# EasyEDA Pro project ProPrj_Starcat_FOC双路矢量控制器_2024-11-11.epro, schematic FOC_cdh_2 (continued)
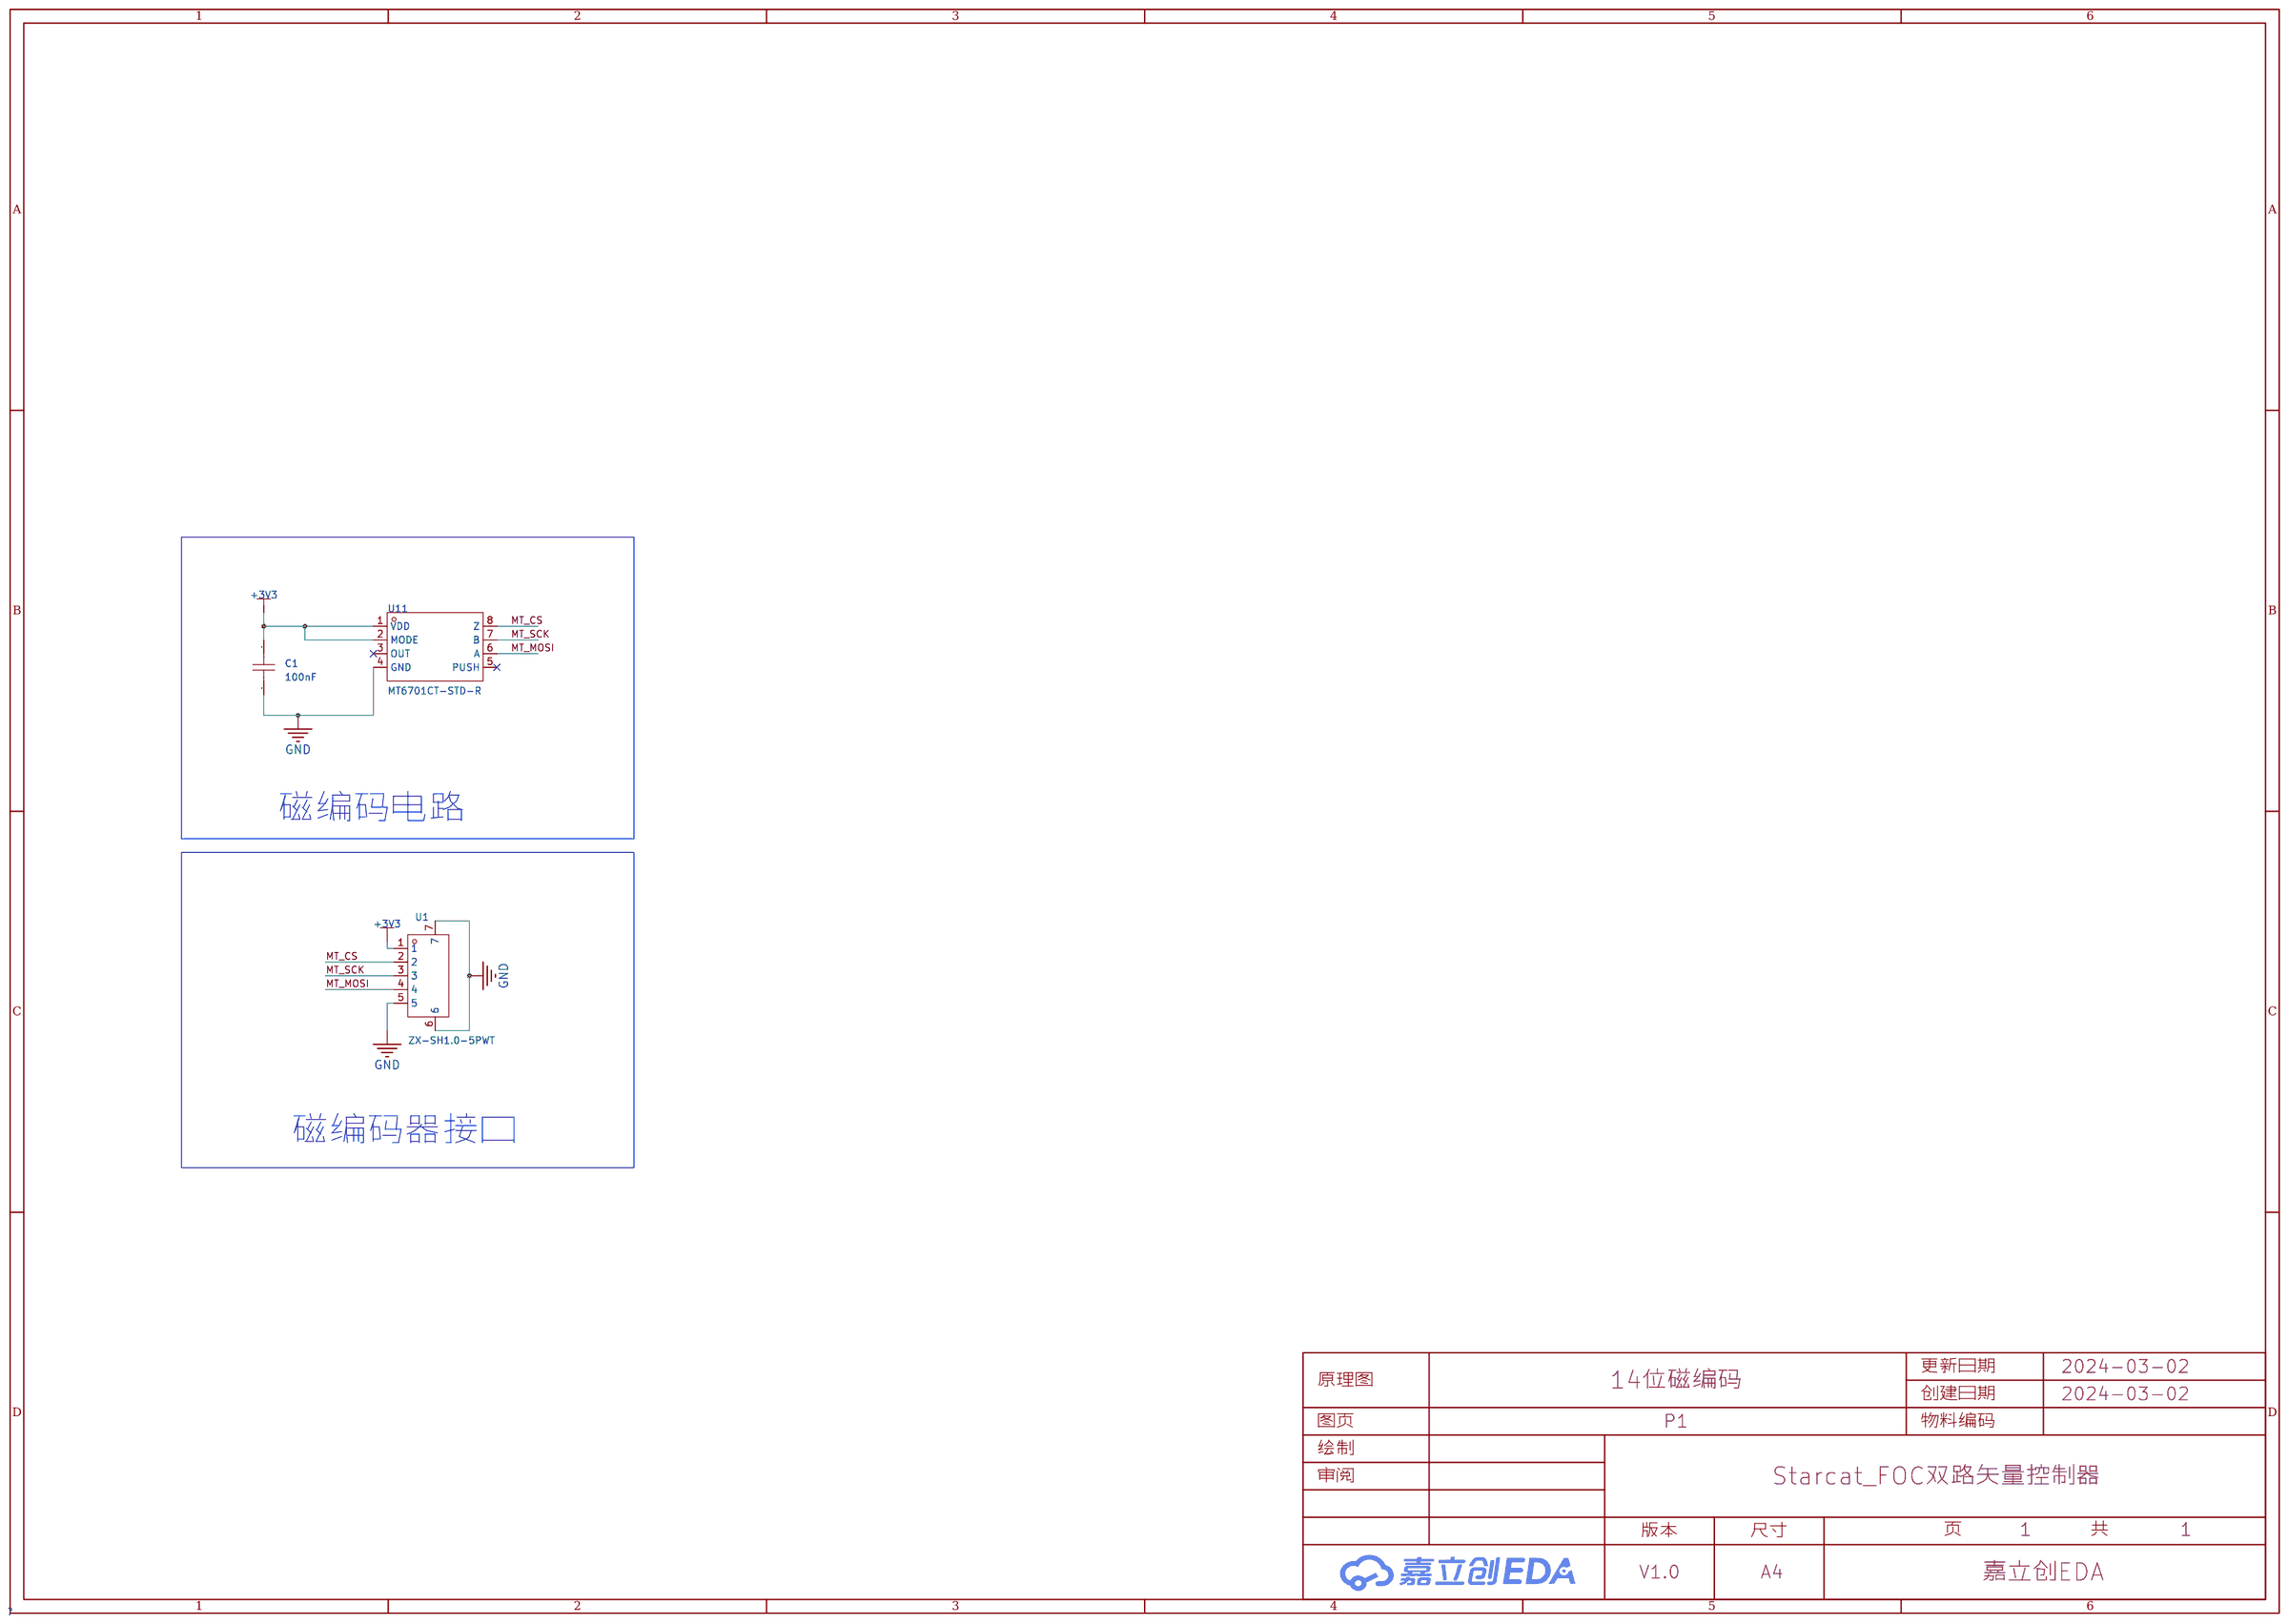
[diagram p0: schematic sheet]
## Library data of the parts (continued)
R18 = 0603WAF5603T5E: 电阻类型:厚膜电阻;阻值:560kΩ;精度:±1%;功率:100mW;最大工作电压:75V;温度系数:±100ppm/℃;; LCSC Part Name: 560kΩ ±1% 100mW 厚膜电阻; Supplier Part: C23203; Manufacturer: UNI-ROYAL(厚声); Supplier Footprint: 0603; JLCPCB Part Class: 扩展库; Datasheet: https://atta.szlcsc.com/upload/public/pdf/source/20200306/C422600_1E6D84923E4A46A82E41ADD87F860B5C.pdf; Supplier: LCSC; Type: 厚膜电阻; Tolerance: ±1%; Power(Watts): 100mW; Overload Voltage (Max): 75V; Temperature Coefficient: ±100ppm/℃; Operating Temperature Range: -55℃~+155℃
R33 R35 R37 R39 R59 R60 = 0603WAF220JT5E: 电阻类型:厚膜电阻;阻值:22Ω;精度:±1%;功率:100mW;最大工作电压:75V;温度系数:±100ppm/℃;; LCSC Part Name: 22Ω ±1% 100mW 厚膜电阻; Supplier Part: C23345; Manufacturer: UNI-ROYAL(厚声); Supplier Footprint: 0603; JLCPCB Part Class: 基础库; Datasheet: https://atta.szlcsc.com/upload/public/pdf/source/20200306/C422600_1E6D84923E4A46A82E41ADD87F860B5C.pdf; Supplier: LCSC; Type: 厚膜电阻; Tolerance: ±1%; Power(Watts): 100mW; Overload Voltage (Max): 75V; Temperature Coefficient: ±100ppm/℃; Operating Temperature Range: -55℃~+155℃
SW1-SW3 = TS24CA 250gf 013: 电路结构:单刀单掷;按钮形状:矩形按钮;作用力:250gf;安装方式:卧贴;开关长度:4.55mm;开关宽度:1.8mm;开关高度:3.5mm;带支架:不带;触点电流:50mA;额定电压(AC):-;额定电压(DC):12V;额定功率:0.6W;绝缘电阻:100MΩ;带灯:无;机械寿命:3万次;; LCSC Part Name: 2*4*3.5mm半包小贝贝TS-018小侧按键m165蓝牙耳机开关 250gf; Supplier Part: C5373430; Manufacturer: SHOU HAN(首韩); Supplier Footprint: SMD; JLCPCB Part Class: 扩展库; Datasheet: https://atta.szlcsc.com/upload/public/pdf/source/20230321/913029B0FB0CD391AF5EFD51697D8EC4.pdf; Supplier: LCSC; Circuit: 单刀单掷; Actuator Style: 矩形按钮; Operating Force: 250gf; Mounting Style: 卧贴; Switch Length: 4.55mm; Switch Width: 1.8mm; Switch Height: 3.5mm; Strike Gundam: 不带; Contact Current: 50mA; Voltage Rating (DC): 12V; Power Rating: 0.6W; Insulation Resistance: 100MΩ; Actuator/Cap Color: 黑色; With Lamp: 无; Mechanical Life: 3万次; Operating Temperature: -40℃~+85℃
TP1-TP4 = Test-Point: Test Point 测试点
U1 = SPX3819M5-L-3-3/TR: 输出类型:固定;最大输入电压:16V;输出电压:3.3V;最大输出电流:500mA;电源纹波抑制比(PSRR):70dB;输出极性:正极;; LCSC Part Name: 输入16V 输出3.3V 500mA; Supplier Part: C9055; Manufacturer: MaxLinear(迈凌); Supplier Footprint: SOT-23-5; JLCPCB Part Class: 扩展库; Datasheet: https://atta.szlcsc.com/upload/public/pdf/source/20150720/1457707331934.pdf; Supplier: LCSC; Output Type: 固定; Maximum Input Voltage: 16V; Output Voltage: 3.3V; MAX Output Current: 500mA; Power Supply Rejection Ratio (PSRR): 70dB; Dropout Voltage: 700mV@(500mA); standby current: 8uA; Operating Temperature: -40℃~+125℃; Output Polarity: 正极; Number of Outputs: 1
U2 = LP5907MFX-3.3/NOPB: 输出类型:固定;最大输入电压:5.5V;输出电压:3.3V;最大输出电流:250mA;电源纹波抑制比(PSRR):90dB;输出极性:正极;; LCSC Part Name: 输入5.5V 输出3.3V 250mA; Supplier Part: C80670; Manufacturer: TI(德州仪器); Supplier Footprint: SOT-23-5; JLCPCB Part Class: 扩展库; Datasheet: https://www.ti.com/cn/lit/gpn/lp5907; Supplier: LCSC; Output Type: 固定; Maximum Input Voltage: 5.5V; Output Voltage: 3.3V; MAX Output Current: 250mA; Power Supply Rejection Ratio (PSRR): 90dB; Dropout Voltage: 250mV@(250mA); standby current: 25uA; Operating Temperature: -40℃~+125℃; Output Polarity: 正极; Number of Outputs: 1
U3 U4 = 舵机驱动
U5 = CH340N: Supplier Part: C2977777; Manufacturer: WCH(南京沁恒); Supplier Footprint: SOP-8; JLCPCB Part Class: Extended Part; Datasheet: https://atta.szlcsc.com/upload/public/pdf/source/20220223/82A45E4FF89B3EDCAD50B354450A7EF4.pdf; Supplier: LCSC
U7 = TLV61046ADBVR: 功能类型:升压型;输出类型:可调;输入电压:1.8V~5.5V;输出电压:3.3V~28V;输出电流(最大值):-;; Supplier Part: C464815; Manufacturer: TI(德州仪器); Supplier Footprint: SOT-23-6; JLCPCB Part Class: 扩展库; Datasheet: https://www.ti.com/cn/lit/gpn/tlv61046a; Supplier: LCSC; Function: 升压型; Output Type: 可调; Input Voltage: 1.8V~5.5V; Output Voltage: 3.3V~28V; Switching Frequency: 1.05MHz; Operating Temperature: -40℃~+125℃@(TJ); Number of Outputs: 1; Topology: 升压式; Switch tube (built-in/external): 内置
U8 U9 = WAFER-SH1.0-2PWB: 插针结构:1x2P;间距:1mm;安装方式:卧贴;总PIN数:2P;排数:1;每排PIN数:2;额定电流:1A;工作温度范围:-25℃~+85℃;; LCSC Part Name: 1x2P 间距:1mm 卧贴; Supplier Part: C3029341; Manufacturer: XUNPU(讯普); Supplier Footprint: SMD,P=1mm,卧贴; JLCPCB Part Class: 扩展库; Datasheet: https://atta.szlcsc.com/upload/public/pdf/source/20220527/1879B8210BD3B2006BCEAC1A40D397B6.pdf; Supplier: LCSC; Pins Structure: 1x2P; Pitch: 1mm; Mounting Style: 卧贴; Number of Pins: 2P; Number of Rows: 1; Number of PINs Per Row: 2; Current Rating (Max): 1A; Operating Temperature Range: -25℃~+85℃
U10 U13 = ZX-SH1.0-5PWT: 插针结构:1x5P;间距:1mm;安装方式:卧贴;参考系列:SH;总PIN数:5P;排数:1;每排PIN数:5;行距:-;额定电流:1A;触头材质:黄铜;触头镀层:锡;工作温度范围:-25℃~+85℃;; Supplier Part: C7430447; Manufacturer: Megastar(兆星); Supplier Footprint: SMD,P=1mm,卧贴; JLCPCB Part Class: 扩展库; Datasheet: https://atta.szlcsc.com/upload/public/pdf/source/20230619/A00B60466F49A3581AA01BB47452619D.pdf; Supplier: LCSC; Pins Structure: 1x5P; Pitch: 1mm; Mounting Style: 卧贴; Reference Series: SH; Number of Pins: 5P; Number of Rows: 1; Number of PINs Per Row: 5; Current Rating (Max): 1A; Contact Material: 黄铜; Contact Plating: 锡; Operating Temperature Range: -25℃~+85℃
U12 = oled-128x80
U16 = STM32F405RGT6: CPU内核:CM4;程序存储容量:1MB;RAM总容量:192KB;GPIO端口数量:51;工作电压范围:1.8V~3.6V;CPU最大主频:168MHz;程序存储器类型:FLASH;; Supplier Part: C15742; Manufacturer: ST(意法半导体); Supplier Footprint: LQFP-64(10x10); JLCPCB Part Class: 扩展库; Datasheet: https://atta.szlcsc.com/upload/public/pdf/source/20140801/1457707197138.pdf; Supplier: LCSC; CPU Core: CM4; Program Storage Size: 1MB; RAM Size: 192KB; GPIO Ports Number: 51; Operating Voltage Range: 1.8V~3.6V; CPU Maximum Speed: 168MHz; Program Memory Type: FLASH; Operating Temperature Range: -40℃~+85℃; ADC (Bit): 12bit; DAC (Bit): 12bit; Universal Serial Bus: 有; Peripheral/Function: DMA；LCD/LED驱动；PWM; Watchdog: 有; Infrared Data Association: 有; Low-Voltage Detect: 有; LCD Module: 有; Direct Memory Access: 有; Internal Oscillator: 有
U19 = SN65HVD232DR: 类型:收发器;数据速率:1Mbps;; LCSC Part Name: 1Mbps 3V~3.6V; Supplier Part: C30530; Manufacturer: TI(德州仪器); Supplier Footprint: SOIC-8; JLCPCB Part Class: 扩展库; Datasheet: https://www.ti.com/cn/lit/gpn/sn65hvd230; Supplier: LCSC; Type: 收发器; Data Rate: 1Mbps; Supply Voltage: 3V~3.6V; Operating Temperature: -40℃~+85℃
USB1 = KH-TYPE-C-16P: 连接器类型:Type-C;标准:-;公母:母座;触点数量:16;端口数量:1;安装方式:卧贴;额定电流 - 电源:3A;工作温度范围:-40℃~+85℃;; LCSC Part Name: Type-C 母座 卧贴; Supplier Part: C709357; Manufacturer: kinghelm(金航标); Supplier Footprint: SMD; JLCPCB Part Class: Extended Part; Datasheet: https://atta.szlcsc.com/upload/public/pdf/source/20200911/C709357_AA8DCEB38BB20E3035A7ED7AE7667837.pdf; Supplier: LCSC; Connector Type: Type-C; Gender: 母座; Number of Contacts: 16; Number of Ports: 1; Mounting Style: 卧贴; Current Rating - Power (Max): 3A; Operating Temperature Range: -40℃~+85℃
X1 = X50328MSB2GI: 晶振类型:贴片无源晶振;频率:8MHz;频率公差:±10ppm;频率稳定度:±50ppm;负载电容:20pF;工作温度:-40℃~+85℃;; LCSC Part Name: YSX530GA 8MHz ±10ppm 20pF; Supplier Part: C115962; Manufacturer: YXC(扬兴晶振); Supplier Footprint: SMD5032-2P; JLCPCB Part Class: 基础库; Datasheet: https://atta.szlcsc.com/upload/public/pdf/source/20210329/C112559_847D3CACBA33ACCEB57DEA3AEBB187A1.pdf; Supplier: LCSC; Crystal Type: 贴片无源晶振; Frequency Tolerance: ±10ppm; Frequency Stability: ±50ppm; Load Capacitance: 20pF; Operating Temperature: -40℃~+85℃
C34-C39 C50-C55 C94 C95 C97 = GRM32ER60J107ME20L: 容值:100uF;精度:±20%;额定电压:6.3V;材质(温度系数):X5R;; LCSC Part Name: 100uF ±20% 6.3V; Supplier Part: C88154; Manufacturer: muRata(村田); Supplier Footprint: 1210; JLCPCB Part Class: 扩展库; Datasheet: https://atta.szlcsc.com/upload/public/pdf/source/20170116/1484561244372.pdf; Supplier: LCSC; Tolerance: ±20%; Voltage Rated: 6.3V; Temperature Coefficient: X5R
C43 = 0603B103K101NT: 容值:10nF;精度:±10%;额定电压:100V;材质(温度系数):X7R;; LCSC Part Name: 10nF ±10% 100V; Supplier Part: C43253; Manufacturer: FH(风华); Supplier Footprint: 0603; JLCPCB Part Class: 扩展库; Datasheet: https://atta.szlcsc.com/upload/public/pdf/source/20200305/C486355_26A10D38EF8C2A5C37091D0039909270.pdf; Supplier: LCSC; Tolerance: ±10%; Voltage Rated: 100V; Temperature Coefficient: X7R
C59 = 0603CG820J500NT: 容值:82pF;精度:±5%;额定电压:50V;材质(温度系数):C0G;; LCSC Part Name: 82pF ±5% 50V; Supplier Part: C1683; Manufacturer: FH(风华); Supplier Footprint: 0603; JLCPCB Part Class: 扩展库; Datasheet: https://atta.szlcsc.com/upload/public/pdf/source/20200305/C486355_26A10D38EF8C2A5C37091D0039909270.pdf; Supplier: LCSC; Tolerance: ±5%; Voltage Rated: 50V; Temperature Coefficient: C0G
C60 = 0603B271K500NT: 容值:270pF;精度:±10%;额定电压:50V;材质(温度系数):X7R;; LCSC Part Name: 270pF ±10% 50V; Supplier Part: C1608; Manufacturer: FH(风华); Supplier Footprint: 0603; Datasheet: https://atta.szlcsc.com/upload/public/pdf/source/20200305/C486355_26A10D38EF8C2A5C37091D0039909270.pdf; Supplier: LCSC; Tolerance: ±10%; Voltage Rated: 50V; Temperature Coefficient: X7R
C61 = 0603B153K500NT: 容值:15nF;精度:±10%;额定电压:50V;材质(温度系数):X7R;; LCSC Part Name: 15nF ±10% 50V; Supplier Part: C1596; Manufacturer: FH(风华); Supplier Footprint: 0603; JLCPCB Part Class: 扩展库; Datasheet: https://atta.szlcsc.com/upload/public/pdf/source/20200305/C486355_26A10D38EF8C2A5C37091D0039909270.pdf; Supplier: LCSC; Tolerance: ±10%; Voltage Rated: 50V; Temperature Coefficient: X7R
C63 = GRM21BR61H106KE43L: 容值:10uF;精度:±10%;额定电压:50V;材质(温度系数):X5R;; LCSC Part Name: 10uF ±10% 50V; Supplier Part: C440198; Manufacturer: muRata(村田); Supplier Footprint: 0805; JLCPCB Part Class: 基础库; Datasheet: https://atta.szlcsc.com/upload/public/pdf/source/20230811/95AAE0C9AF55EDC31B7A4D8B733F534E.pdf; Supplier: LCSC; Tolerance: ±10%; Voltage Rated: 63V; Temperature Coefficient: X5R
C65 = GRM32ER60J107ME20L: 容值:100uF;精度:±20%;额定电压:6.3V;材质(温度系数):X5R;; LCSC Part Name: 100uF ±20% 6.3V; Supplier Part: C88154; Manufacturer: muRata(村田); Supplier Footprint: 1210; JLCPCB Part Class: 扩展库; Datasheet: https://atta.szlcsc.com/upload/public/pdf/source/20170116/1484561244372.pdf; Supplier: LCSC; Tolerance: ±20%; Voltage Rated: 63V; Temperature Coefficient: X5R
C70 C73 = AC0603KRX7R0BB473: 容值:47nF;精度:±10%;额定电压:100V;材质(温度系数):X7R;; LCSC Part Name: 47nF ±10% 100V; Supplier Part: C469624; Manufacturer: YAGEO(国巨); Supplier Footprint: 0603; JLCPCB Part Class: 扩展库; Datasheet: https://atta.szlcsc.com/upload/public/pdf/source/20191217/C469624_84C34F492B76C2BCBA39E88472E4BE3D.pdf; Supplier: LCSC; Tolerance: ±10%; Voltage Rated: 100V; Temperature Coefficient: X7R
C78-C81 C84 C86 C87 C89 = 0603B222K500NT: 容值:2.2nF;精度:±10%;额定电压:50V;材质(温度系数):X7R;; LCSC Part Name: 2.2nF ±10% 50V; Supplier Part: C1604; Manufacturer: FH(风华); Supplier Footprint: 0603; JLCPCB Part Class: 基础库; Datasheet: https://atta.szlcsc.com/upload/public/pdf/source/20200305/C486355_26A10D38EF8C2A5C37091D0039909270.pdf; Supplier: LCSC; Tolerance: ±10%; Voltage Rated: 50V; Temperature Coefficient: X7R
D2 = SMBJ60CA_C115824: 反向截止电压(Vrwm):60V;最大钳位电压:96.8V;峰值脉冲电流(Ipp)@10/1000us:6.2A;击穿电压:66.7V;; LCSC Part Name: 双向TVS 60V截止 6.2A峰值脉冲; Supplier Part: C115824; Manufacturer: MDD; Supplier Footprint: SMB(DO-214AA); JLCPCB Part Class: 扩展库; Datasheet: https://atta.szlcsc.com/upload/public/pdf/source/20230314/C8F66EF07395B88C11214ABD10019202.pdf; Supplier: LCSC; Reverse Stand-Off Voltage (Vrwm): 60V; Maximum Clamping Voltage: 96.8V; Peak Pulse Current (Ipp)@10/1000us: 6.2A; Breakdown Voltage: 66.7V; Reverse Leakage Current (Ir): 1uA; Type: TVS
D3 = SS56_C727066: 二极管配置:独立式;正向压降(Vf):700mV@5A;直流反向耐压(Vr):60V;平均整流电流(Io):5A;; LCSC Part Name: 电压:60V 电流:5A; Supplier Part: C727066; Manufacturer: TWGMC(台湾迪嘉); Supplier Footprint: SMA(DO-214AC); JLCPCB Part Class: 扩展库; Datasheet: https://atta.szlcsc.com/upload/public/pdf/source/20200828/C727064_BD0A2B36CBC76CEA4B6710C57718D41F.pdf; Supplier: LCSC; Diode Configuration: 独立式; Forward Voltage (Vf@If): 700mV@5A; Reverse Voltage (Vr): 60V; Average Rectified Current (Io): 5A; Reverse Leakage Current (Ir): 500uA@60V
L2 = YNR4030-220M: 电感值:22uH;精度:±20%;额定电流:1A;; LCSC Part Name: 22uH ±20%; Supplier Part: C341013; Manufacturer: YJYCOIN(益嘉源); Supplier Footprint: SMD,4x4x3mm; JLCPCB Part Class: 扩展库; Datasheet: https://atta.szlcsc.com/upload/public/pdf/source/20200623/C340386_9AA10DB3E9692149FF2BB278AFBCE083.pdf; Supplier: LCSC; Tolerance: ±20%; Rated Current: 1A; DC Resistance (DCR): 225mΩ
Q1-Q12 = BSC0702LS: 类型:N沟道;漏源电压(Vdss):60V;连续漏极电流(Id):100A;功率(Pd):83W;导通电阻(RDS(on)@Vgs,Id):2.3mΩ@10V,50A;阈值电压(Vgs(th)@Id):2.3V@49uA;; Supplier: LCSC; Supplier Part: C501503; Manufacturer: Infineon(英飞凌); JLCPCB Part Class: 扩展库; LCSC Part Name: N沟道 耐压:60V 电流:100A; Supplier Footprint: TDSON-8-EP(5x6); Datasheet: https://atta.szlcsc.com/upload/public/pdf/source/20200324/C501503_BE3C55BAEEDCAD77F3934BFEE5415F86.pdf; Type: N沟道; Drain Source Voltage (Vdss): 60V; Continuous Drain Current (Id): 100A; Power Dissipation (Pd): 83W; Drain Source On Resistance (RDS(on)@Vgs,Id): 2.3mΩ@10V,50A; Gate Threshold Voltage (Vgs(th)@Id): 2.3V@49uA
R20 = 0603WAF330KT5E: 电阻类型:厚膜电阻;阻值:3.3Ω;精度:±1%;功率:100mW;最大工作电压:75V;温度系数:±400ppm/℃;; LCSC Part Name: 3.3Ω ±1% 100mW 厚膜电阻; Supplier Part: C22979; Manufacturer: UNI-ROYAL(厚声); Supplier Footprint: 0603; JLCPCB Part Class: 扩展库; Datasheet: https://atta.szlcsc.com/upload/public/pdf/source/20200306/C422600_1E6D84923E4A46A82E41ADD87F860B5C.pdf; Supplier: LCSC; Type: 厚膜电阻; Tolerance: ±1%; Power(Watts): 100mW; Overload Voltage (Max): 75V; Temperature Coefficient: ±400ppm/℃; Operating Temperature Range: -55℃~+155℃
R21 = 0603WAF3902T5E: 电阻类型:厚膜电阻;阻值:39kΩ;精度:±1%;功率:100mW;最大工作电压:75V;温度系数:±100ppm/℃;; LCSC Part Name: 39kΩ ±1% 100mW 厚膜电阻; Supplier Part: C23153; Manufacturer: UNI-ROYAL(厚声); Supplier Footprint: 0603; JLCPCB Part Class: 基础库; Datasheet: https://atta.szlcsc.com/upload/public/pdf/source/20200306/C422600_1E6D84923E4A46A82E41ADD87F860B5C.pdf; Supplier: LCSC; Type: 厚膜电阻; Tolerance: ±1%; Power(Watts): 100mW; Overload Voltage (Max): 75V; Temperature Coefficient: ±100ppm/℃; Operating Temperature Range: -55℃~+155℃
R22 R23 = NCP18XH103F03RB: 阻值(25℃):10kΩ;B值(25℃/50℃):3380K;电阻精度:±1%;功率:100mW;B值精度:±1%;最大稳态电流(25℃):310uA;; LCSC Part Name: 10kΩ 电阻精度:±1% 3380K; Supplier Part: C13564; Manufacturer: muRata(村田); Supplier Footprint: 0603; JLCPCB Part Class: 扩展库; Datasheet: https://atta.szlcsc.com/upload/public/pdf/source/20130819/1457706638081.pdf; Supplier: LCSC; Resistance @ 25℃: 10kΩ; B Constant (25℃/50℃): 3380K; Resistance Tolerance: ±1%; B Constant (25℃/85℃): 3434K; B Constant (25℃/100℃): 3455K; Power: 100mW; B Constant Tolerance: ±1%; Steady State Current (Max): 310uA; Operating Temperature: -40℃~+125℃
R24 = 0603WAF2201T5E: 电阻类型:厚膜电阻;阻值:2.2kΩ;精度:±1%;功率:100mW;最大工作电压:75V;温度系数:±100ppm/℃;; LCSC Part Name: 2.2kΩ ±1% 100mW 厚膜电阻; Supplier Part: C4190; Manufacturer: UNI-ROYAL(厚声); Supplier Footprint: 0603; JLCPCB Part Class: 基础库; Datasheet: https://atta.szlcsc.com/upload/public/pdf/source/20200306/C422600_1E6D84923E4A46A82E41ADD87F860B5C.pdf; Supplier: LCSC; Type: 厚膜电阻; Tolerance: ±1%; Power(Watts): 100mW; Overload Voltage (Max): 75V; Temperature Coefficient: ±100ppm/℃; Operating Temperature Range: -55℃~+155℃
R27 = RMC060347K5%N: 阻值:47kΩ;精度:±5%;功率:100mW;; LCSC Part Name: 47kΩ ±5% 100mW; Supplier Part: C269695; Manufacturer: Tyohm(幸亚电阻); Supplier Footprint: 0603; Datasheet: https://atta.szlcsc.com/upload/public/pdf/source/20190115/C325956_D27151D492FFB3C9AB4A6F14FE01F30A.pdf; Supplier: LCSC; Tolerance: ±5%; Power(Watts): 100mW
R28 = 0603WAF2203T5E: 电阻类型:厚膜电阻;阻值:220kΩ;精度:±1%;功率:100mW;最大工作电压:75V;温度系数:±100ppm/℃;; LCSC Part Name: 220kΩ ±1% 100mW 厚膜电阻; Supplier Part: C22961; Manufacturer: UNI-ROYAL(厚声); Supplier Footprint: 0603; JLCPCB Part Class: 基础库; Datasheet: https://atta.szlcsc.com/upload/public/pdf/source/20200306/C422600_1E6D84923E4A46A82E41ADD87F860B5C.pdf; Supplier: LCSC; Type: 厚膜电阻; Tolerance: ±1%; Power(Watts): 100mW; Overload Voltage (Max): 75V; Temperature Coefficient: ±100ppm/℃; Operating Temperature Range: -55℃~+155℃
R29 R31 R32 = 0603WAF1802T5E: 电阻类型:厚膜电阻;阻值:18kΩ;精度:±1%;功率:100mW;最大工作电压:75V;温度系数:±100ppm/℃;; LCSC Part Name: 18kΩ ±1% 100mW 厚膜电阻; Supplier Part: C25810; Manufacturer: UNI-ROYAL(厚声); Supplier Footprint: 0603; JLCPCB Part Class: 基础库; Datasheet: https://atta.szlcsc.com/upload/public/pdf/source/20200306/C422600_1E6D84923E4A46A82E41ADD87F860B5C.pdf; Supplier: LCSC; Type: 厚膜电阻; Tolerance: ±1%; Power(Watts): 100mW; Overload Voltage (Max): 75V; Temperature Coefficient: ±100ppm/℃; Operating Temperature Range: -55℃~+155℃
R41-R52 = 0603WAF220KT5E: 电阻类型:厚膜电阻;阻值:2.2Ω;精度:±1%;功率:100mW;最大工作电压:75V;温度系数:±400ppm/℃;; LCSC Part Name: 2.2Ω ±1% 100mW 厚膜电阻; Supplier Part: C22939; Manufacturer: UNI-ROYAL(厚声); Supplier Footprint: 0603; JLCPCB Part Class: 基础库; Datasheet: https://atta.szlcsc.com/upload/public/pdf/source/20200306/C422600_1E6D84923E4A46A82E41ADD87F860B5C.pdf; Supplier: LCSC; Type: 厚膜电阻; Tolerance: ±1%; Power(Watts): 100mW; Overload Voltage (Max): 75V; Temperature Coefficient: ±400ppm/℃; Operating Temperature Range: -55℃~+155℃
R53-R56 = HoJLR2512-3W-10mR-1%: 电阻类型:采样电阻;阻值:10mΩ;精度:±1%;功率:3W;安装方式:贴片;; LCSC Part Name: 10mΩ ±1% 3W; Supplier Part: C2903468; Manufacturer: Milliohm(毫欧); Supplier Footprint: 2512; JLCPCB Part Class: 扩展库; Datasheet: https://atta.szlcsc.com/upload/public/pdf/source/20211009/7525CABAB363C979E942C1DD41F1FEF0.pdf; Supplier: LCSC; Type: 采样电阻; Tolerance: ±1%; Power(Watts): 3W; Mounting Sytle: 贴片
U11 = 电源接口
U17 U18 = DRV8301DCAR: 驱动电机类型:无刷直流BLDC;电源电压:6V~60V;输出电流:-;接口:SPI,STEP/DIR;; LCSC Part Name: 无刷直流BLDC电机驱动芯片 60V; Supplier Part: C98969; Manufacturer: TI(德州仪器); Supplier Footprint: HTSSOP-56-6mm; JLCPCB Part Class: 扩展库; Datasheet: https://www.ti.com/cn/lit/gpn/drv8301; Supplier: LCSC; Drive motor type: 无刷直流BLDC; Supply Voltage: 6V~60V; Interface: SPI,STEP/DIR; Operating Temperature: -40℃~+125℃@(Ta)
U20 U21 = MR30PW-M30.G.Y: LCSC Part Name: MR30PW20三芯PCB 弯插公金黄H=3mm; Supplier Part: C19268036; Manufacturer: AMASS(艾迈斯); JLCPCB Part Class: 扩展库; Datasheet: https://atta.szlcsc.com/upload/public/pdf/source/20231221/E63D24EDC016665263C6304FABBAAC61.pdf; Supplier: LCSC

## Nets
+3V3: C6.2 C7.1 C10.1 C11.1 C12.1 C13.1 C14.2 C21.1 C24.2 C27.1 C29.2 CN1.4 CN2.4 L5.2 R1.2 R2.1 R3.2 R7.1 R9.1 R11.2 R12.2 R13.2 R15.2 R16.2 R17.2 R58.2 TP2.1 U1.5(OUT) U5.5(VCC) U7.4(EN) U7.6(VIN) U10.1 U12.4(VDD) U13.1 U16.1(VBAT) U16.19(VDD) U16.32(VDD) U16.48(VDD) U16.64(VDD) U17.49(VDD-SPI) U18.49(VDD-SPI) U19.3(VCC)
+3V3_VDA: C5.1 L3.2 U16.13(VDDA)
+3V3A: C3.1 C8.2 L3.1 R22.2 R23.2 TP3.1 U2.5(OUT) U17.24(REF) U18.24(REF)
+5V: C1.1 C2.2 C4.2 C65.2 D1.2(C) L2.2 R29.1 TP4.1 U1.1(IN) U1.3(EN) U2.1(IN) U2.3(EN) U3.1 U4.1
+9V: C25.2 C26.2 R10.2 U7.5(VOUT) U12.2(VPP)
AGND: C1.2 C2.1 C3.2 C4.1 C6.1 C7.2 C8.1 C9.1 C10.2 C11.2 C12.2 C13.2 C14.1 C15.1 C16.2 C17.1 C18.2 C19.1 C20.1 C21.2 C23.1 C24.1 C25.1 C26.1 C27.2 C28.2 C29.1 C30.1 C45.1 C46.1 C59.1 C60.1 C61.2 C62.2 C63.1 C65.1 C68.1 C71.1 C76.2 C77.2 C80.1 C81.1 C82.1 C83.1 C84.1 C85.2 C87.1 C88.2 C98.1 CN1.1 CN2.3 CN2.5 CN2.6 D3.1(A) L1.1 L4.1 LED1.2(K) LED3.2(K) R4.2 R14.1 R18.1 R24.1 R25.1 R26.1 R28.2 R30.1 R31.2 R32.2 SW1.2 SW2.2 SW3.2 TP1.1 U1.2(GND) U2.2(GND) U3.2 U4.2 U5.3(GND) U7.2(GND) U10.5 U10.6 U10.7 U12.5(IM1) U12.7(CS) U12.12(VSS) U13.5 U13.6 U13.7 U16.18(VSS) U16.63(VSS) U17.28(AGND) U17.57(EP) U18.28(AGND) U18.55(EN-BUCK) U18.57(EP) U19.2(GND) USB1.A1(GND) USB1.A12(GND) USB1.B1(GND) USB1.B12(GND)
GND_VDA: C5.2 L4.2 U16.12(VSSA)
PGND: C34.1 C35.1 C36.1 C37.1 C38.1 C39.1 C41.2 C43.1 C50.1 C51.1 C52.1 C53.1 C54.1 C55.1 C57.2 C78.1 C79.1 C86.1 C89.1 C94.1 C95.1 C97.1 D2.1(A2) L1.2 Q7.1(S) Q7.2(S) Q7.3(S) Q12.1(S) Q12.2(S) Q12.3(S) R53.1 R54.1 R55.1 R56.1 U11.2 U17.30(SP2) U17.32(SP1) U17.44(SL-A) U18.30(SP2) U18.32(SP1) U18.44(SL-A)
VBUS_5V: F1.1 R57.2 USB1.A4(VBUS) USB1.A9(VBUS) USB1.B4(VBUS) USB1.B9(VBUS)
AH_1: U16.41(PA8) U17.17(INH-A)
AH_2: U16.37(PC6) U18.17(INH-A)
AL_1: U16.34(PB13) U17.18(INL-A)
AL_2: U16.23(PA7) U18.18(INL-A)
AO_1: C66.2 Q4.1(S) Q4.2(S) Q4.3(S) Q12.5(D) Q12.6(D) Q12.7(D) Q12.8(D) U17.46(SH-A) U21.3
AO_2: C67.2 Q1.1(S) Q1.2(S) Q1.3(S) Q7.5(D) Q7.6(D) Q7.7(D) Q7.8(D) U18.46(SH-A) U20.3
BH_1: U16.42(PA9) U17.19(INH-B)
BH_2: U16.38(PC7) U18.19(INH-B)
BL_1: U16.35(PB14) U17.20(INL-B)
BL_2: U16.26(PB0) U18.20(INL-B)
BO_1: C69.2 Q5.1(S) Q5.2(S) Q5.3(S) Q10.5(D) Q10.6(D) Q10.7(D) Q10.8(D) U17.41(SH-B) U21.2
BO_2: C72.2 Q2.1(S) Q2.2(S) Q2.3(S) Q8.5(D) Q8.6(D) Q8.7(D) Q8.8(D) U18.41(SH-B) U20.2
CAN_H: R8.2 U8.2 U9.1 U19.7(CANH)
CAN_L: R8.1 U8.1 U9.2 U19.6(CANL)
CAN_RX: U16.61(PB8) U19.4(R)
CAN_TX: U16.62(PB9) U19.1(D)
CH_1: U16.43(PA10) U17.21(INH-C)
CH_2: U16.39(PC8) U18.21(INH-C)
CL_1: U16.36(PB15) U17.22(INL-C)
CL_2: U16.27(PB1) U18.22(INL-C)
CO_1: C74.2 Q6.1(S) Q6.2(S) Q6.3(S) Q11.5(D) Q11.6(D) Q11.7(D) Q11.8(D) U17.36(SH-C) U21.1
CO_2: C75.2 Q3.1(S) Q3.2(S) Q3.3(S) Q9.5(D) Q9.6(D) Q9.7(D) Q9.8(D) U18.36(SH-C) U20.1
CS_ENC_A_1: R15.1 U13.2 U16.56(PB4(NJTRST))
CS_ENC_A_2: R11.1 U10.2 U16.58(PB6)
D+: U5.1(UD+) USB1.A6(DP1)
D-: U5.2(UD-) USB1.A7(DN1)
DCBUS: C34.2 C35.2 C36.2 C37.2 C38.2 C39.2 C41.1 C50.2 C51.2 C52.2 C53.2 C54.2 C55.2 C57.1 C62.1 C63.2 C85.1 C88.1 C94.2 C95.2 C97.2 D2.2(A1) Q1.5(D) Q1.6(D) Q1.7(D) Q1.8(D) Q2.5(D) Q2.6(D) Q2.7(D) Q2.8(D) Q3.5(D) Q3.6(D) Q3.7(D) Q3.8(D) Q4.5(D) Q4.6(D) Q4.7(D) Q4.8(D) Q5.5(D) Q5.6(D) Q5.7(D) Q5.8(D) Q6.5(D) Q6.6(D) Q6.7(D) Q6.8(D) R20.2 R21.2 U11.1 U17.29(PVDD1) U17.53(PVDD2) U17.54(PVDD2) U18.29(PVDD1)
EN_GATE: U16.33(PB12) U17.16(EN-GATE) U18.16(EN-GATE)
GH_A_1: R44.1 U17.47(GH-A)
GH_A_2: R41.1 U18.47(GH-A)
GH_B_1: R45.1 U17.42(GH-B)
GH_B_2: R42.1 U18.42(GH-B)
GH_C_1: R46.1 U17.37(GH-C)
GH_C_2: R43.1 U18.37(GH-C)
GL_A_1: R52.1 U17.45(GL-A)
GL_A_2: R47.1 U18.45(GL-A)
GL_B_1: R50.1 U17.40(GL-B)
GL_B_2: R48.1 U18.40(GL-B)
GL_C_1: R51.1 U17.35(GL-C)
GL_C_2: R49.1 U18.35(GL-C)
LED1: LED2.2(K) U16.50(PA15(JTDI))
MOSI_ENC_Z_1: R17.1 U13.4 U16.40(PC9)
MOSI_ENC_Z_2: R13.1 U10.4 U16.4(PC15-OSC32_OUT(PC15))
NFAULT_1: U16.54(PD2) U17.6(NFAULT)
NFAULT_2: U16.55(PB3(JTDOTRACESWO)) U18.6(NFAULT)
NRST: C9.2 R2.2 SW1.1 U16.7(NRST)
NSCS_1: U16.2(PC13) U17.8(NSCS)
NSCS_2: U16.3(PC14-OSC32_IN(PC14)) U18.8(NSCS)
OLED_DC: U12.9(DC) U16.28(PB2-BOOT1(PB2))
OLED_SCL: U12.10(D0) U16.29(PB10)
OLED_SDA: U12.11(D1) U16.30(PB11)
OSC_IN: C16.1 R5.2 U16.5(PH0-OSC_IN(PH0)) X1.2(OSC2)
OSC_OUT: C18.1 R5.1 U16.6(PH1-OSC_OUT(PH1)) X1.1(OSC1)
RX: CN2.1 U5.6(TXD) U16.15(PA1)
SCK_ENC_B_1: R16.1 U13.3 U16.57(PB5)
SCK_ENC_B_2: R12.1 U10.3 U16.59(PB7)
SERVO0: U3.3 U16.16(PA2)
SERVO1: U4.3 U16.17(PA3)
SL_B_1: Q10.1(S) Q10.2(S) Q10.3(S) R34.2 R55.2 U17.39(SL-B)
SL_B_2: Q8.1(S) Q8.2(S) Q8.3(S) R36.2 R53.2 U18.39(SL-B)
SL_C_1: Q11.1(S) Q11.2(S) Q11.3(S) R38.2 R56.2 U17.34(SL-C)
SL_C_2: Q9.1(S) Q9.2(S) Q9.3(S) R40.2 R54.2 U18.34(SL-C)
SO1_1: C80.2 R33.1 U16.8(PC0)
SO1_2: C81.2 R35.1 U16.10(PC2)
SO2_1: C84.2 R37.1 U16.9(PC1)
SO2_2: C87.2 R39.1 U16.11(PC3)
SPI_MISO: U16.52(PC11) U17.10(SDO) U18.10(SDO)
SPI_MOSI: U16.53(PC12) U17.9(SDI) U18.9(SDI)
SPI_SCK: U16.51(PC10) U17.11(SCLK) U18.11(SCLK)
SW1: C20.2 R7.2 SW2.1 U16.24(PC4)
SW2: C23.2 R9.2 SW3.1 U16.21(PA5)
SWCLK: CN1.2 U16.49(PA14(JTCK-SWCLK))
SWDIO: CN1.3 U16.46(PA13(JTMS-SWDIO))
TEMP1: C45.2 R22.1 R25.2 U16.25(PC5)
TEMP2: C46.2 R23.1 R26.2 U16.20(PA4)
TX: CN2.2 U5.7(RXD) U16.14(PA0-WKUP(PA0))
USB_DM: R59.2 U16.44(PA11)
USB_DP: R60.2 U16.45(PA12)
V_BUS: C98.2 R21.1 R24.2 U16.22(PA6)
$1N4229: R59.1 USB1.B7(DN2)
$1N4231: R60.1 USB1.B6(DP2)
$1N4243: C19.2 U5.8(V3)
$1N23108: LED2.1(A) R3.1
$1N53421: LED3.1(A) R57.1
$1N65020: C15.2 U16.31(VCAP_1)
$1N65024: C17.2 U16.47(VCAP_2)
$1N65085: R4.1 U16.60(BOOT0)
$1N74568: D1.1(A) F1.2
$1N75995: LED1.1(A) R1.1
$1N76614: C30.2 R58.1 U12.8(RES)
$1N76797: C28.1 U12.3(VCOMH)
$1N76851: R18.2 U12.6(IREF)
$1N77635: R10.1 R14.2 U7.3(FB)
$1N77907: L5.1 U7.1(SW)
$2N6130: R28.1 U17.1(RT-CLK)
$2N6321: C64.2 U17.52(BST-BK)
$2N6405: C64.1 D3.2(K) L2.1 U17.50(PH) U17.51(PH)
$2N6739: R29.2 R30.2 U17.3(VSENSE)
$2N6794: R32.1 U17.7(DTC)
$2N8342: C60.2 R27.1
$2N8350: C59.2 R27.2 U17.2(COMP)
$2N8743: C78.2 R34.1 U17.33(SN1)
$2N8848: C86.2 R38.1 U17.31(SN2)
$2N8926: C66.1 U17.48(BST-A)
$2N9079: C69.1 U17.43(BST-B)
$2N9128: C74.1 U17.38(BST-C)
$2N9379: R33.2 U17.25(SO1)
$2N9879: C76.1 U17.23(DVDD)
$2N9964: C70.2 U17.14(CP1)
$2N9968: C70.1 U17.15(CP2)
$2N10075: C68.2 U17.13(GVDD)
$2N10523: Q1.4(G) R41.2
$2N10526: Q7.4(G) R47.2
$2N10840: Q2.4(G) R42.2
$2N10842: Q8.4(G) R48.2
$2N11117: Q3.4(G) R43.2
$2N11119: Q9.4(G) R49.2
$2N13932: R31.1 U18.7(DTC)
$2N13948: C79.2 R36.1 U18.33(SN1)
$2N13963: C89.2 R40.1 U18.31(SN2)
$2N13976: C67.1 U18.48(BST-A)
$2N13991: C72.1 U18.43(BST-B)
$2N14006: C75.1 U18.38(BST-C)
$2N14021: R39.2 U18.26(SO2)
$2N14030: R35.2 U18.25(SO1)
$2N14048: C83.2 U18.27(AVDD)
$2N14053: C77.1 U18.23(DVDD)
$2N14079: C73.2 U18.14(CP1)
$2N14081: C73.1 U18.15(CP2)
$2N14085: C71.2 U18.13(GVDD)
$2N14090: Q4.4(G) R44.2
$2N14092: Q12.4(G) R52.2
$2N14112: Q5.4(G) R45.2
$2N14114: Q10.4(G) R50.2
$2N14127: Q6.4(G) R46.2
$2N14129: Q11.4(G) R51.2
$2N20113: C82.2 U17.27(AVDD)
$2N20114: R37.2 U17.26(SO2)
$2N20875: C43.2 R20.1
$2N21611: C61.1 U17.56(SS-TR)

Not connected (* = marked no-connect by the designer): CN1 5* 6*; SW1 3* 4*; SW2 3* 4*; SW3 3* 4*; U1 4(BYP)*; U2 4(N/C)*; U5 4(RTS#)*; U8 3* 4*; U9 3* 4*; U12 1(NC)* 13(NC)*; U17 4(PWRGD)* 5(NOCTW)* 12(DC-CAL)* 55(EN-BUCK)*; U18 1(RT-CLK)* 2(COMP)* 3(VSENSE)* 4(PWRGD)* 5(NOCTW)* 12(DC-CAL)* 50(PH)* 51(PH)* 52(BST-BK)* 53(PVDD2)* 54(PVDD2)* 56(SS-TR)*; U19 5(NC)* 8(NC)*; U20 4* 5*; U21 4* 5*; USB1 1(EP)* 2(EP)* 3(EP)* 4(EP)* A5(CC1)* A8(SUB1)* B5(CC2)* B8(SUB2)*

## Notes on the sheets
sheet 1
- 0.6V
- MCU电源+隔离
- 串口反倒灌
- +3V3电源指示灯（绿色/2.8V）
- 5V稳压3.3V（MCU供电）
- 5V稳压3.3V（adc供电）
- 有几个VDD就有几个100nf，靠近VDD
- 复位按键
- MCU电源滤波电路
- 1.电脑串口是TYPE-A口，TYPE-A->TYPE-C， CC1，CC2可悬空
  2.TYPE-C->TYPE-C,CC1,CC2得接5.1kΩ下拉接地
- LED系统状态指示电路
- 外部晶振电路
- SWD烧录接口
- stm32F405RGT6最小系统电路
- 测试点
- 双路舵机接口
- 实际板上不焊接电容，方便按键连按检测
- typeC+CH340串口电路
- can的电源没有加滤波电容！！！
- 用户按键电路
- 6-48V输入-单相10A，总线30A
- CAN总线收发
- OLED升压供电电路
- 串口通信接口
- 双路磁编码器/霍尔编码器接口
- OLED驱动电路
sheet 2
- 瞬态抑制二极管
- 用淘宝买的100uf/63v/1210的贴片电容
- RC滤波电路
- 各地单点相连
- 电源输入电路
- 电源电压检测
- 双路温度检测
- 电源滤波电路
- 双路三相输出
- 1.两分压电阻越靠近
    VSENSE引脚越好
  2.NOCTW和NFAULT
    需要上拉输入
- 死区时间最小104ns
- 死区时间最小50+3*18=104ns
- 1.AVDD-内部6V
  2.GVDD-栅极驱动电压-一般11V
  3.DVDD-内部3.3V
- DRV8301外围电路-1
- DRV8301外围电路-2
- 1.NMOS--Qg越小越好
  2.导通电阻越小越好
- 三相无刷驱动NMOS电路-1
- 三相无刷驱动NMOS电路-2
